# EasyEDA Pro project Geacon3.eprj, board Geacon_top2
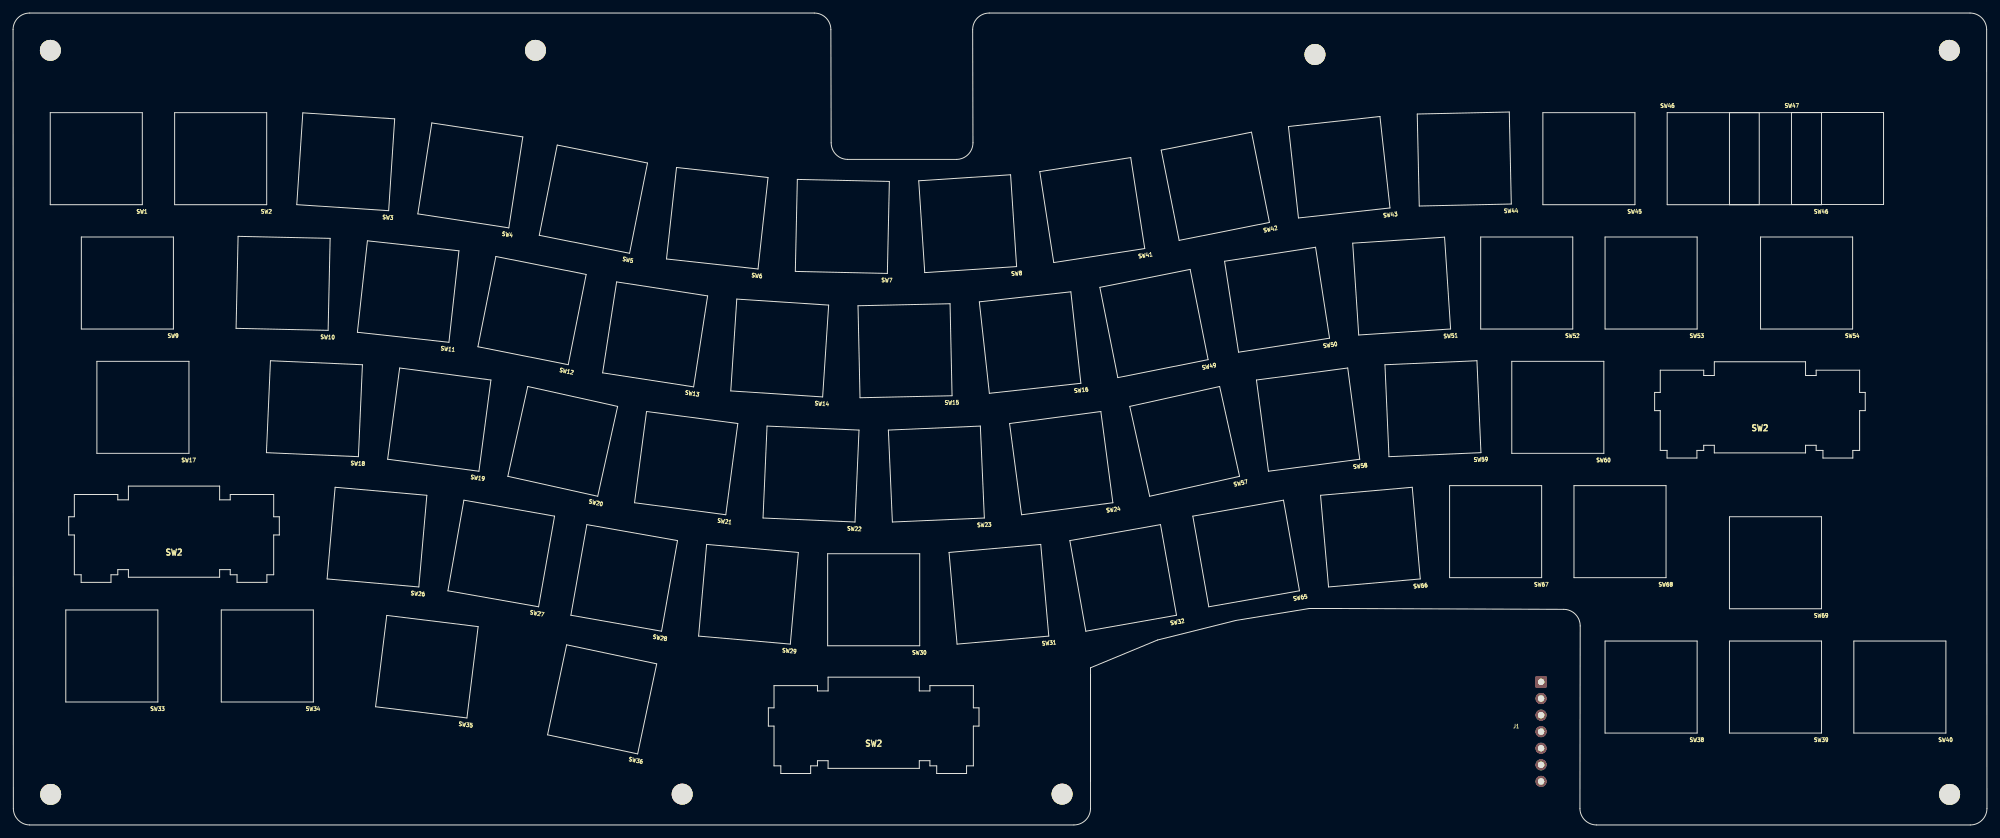
[diagram p5: board, top side]
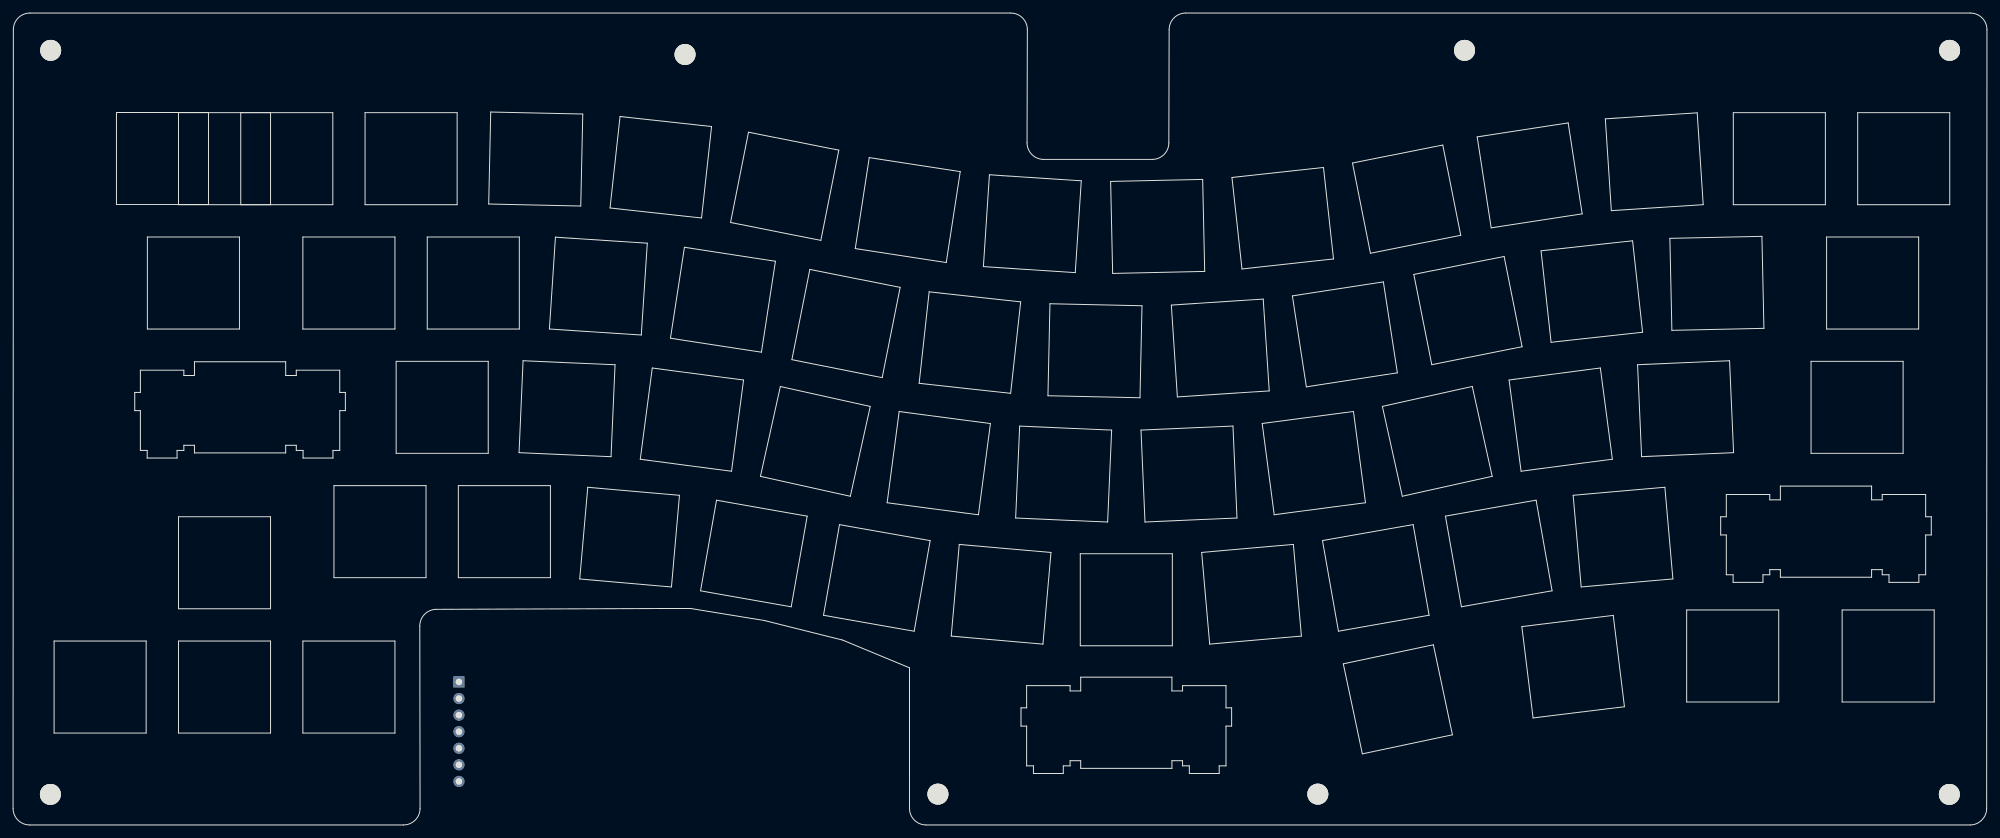
[diagram p6: board, bottom side, seen from below]

Outline 302.31 x 124.41 mm; copper layers: Top Layer, Bottom Layer. Coordinates in mm from the lower left corner of the outline.
Outline path: 165.02,22.94 165.02,6.73 ; 0,121.87 arc(0.74,123.66) 2.54,124.41 122.71,124.41 arc(124.51,123.66) 125.25,121.87 125.29,104.52 arc(126.04,102.73) 127.83,101.98 144.47,101.98 arc(146.27,102.73) 147.01,104.52 146.97,121.87 arc(147.71,123.66) 149.5,124.41 299.72,124.41 arc(301.52,123.66) 302.26,121.87 302.31,2.54 arc(301.56,0.74) 299.76,0 242.51,0 arc(240.72,0.74) 239.97,2.54 240.01,30.5 arc(239.27,32.29) 237.47,33.04 203.01,33.16 198.51,33.16 187.27,31.33 175.27,28.33 165.02,24.08 165.02,2.54 arc(164.27,0.74) 162.47,0 2.52,0 arc(0.76,0.77) 0.04,2.54 0,121.87
Stack: Top Layer 0.035mm / Dielectric1 1.51mm FR4 er 4.5 / Bottom Layer 0.035mm

## Design rules (mm)
spacing safeClearance (default): track to track 0.152, other pairs 0.152 to 0.3
track width trackWidth (default): min 0.127, default 0.254, max 2.54
differential pair differentialPair (default): width min 0.127, default 0.254, max 2.54; gap min 0.152, default 0.152
via viaSize (default): diameter min 0.5, default 0.61, max 10; hole min 0.3, default 0.305, max 6
net GND uses CopperRegion1

## Placement (name value [footprint] x y rotation side)
J1  ~  [roBa:pmw3610_connector]  234.02 14.29 0 top
REF**  -  [MountingHole:MountingHole_3.2mm_M3]  5.71 118.69 0 top
REF**#2  -  [MountingHole:MountingHole_3.2mm_M3]  80.01 118.69 0 top
REF**#3  -  [MountingHole:MountingHole_3.2mm_M3]  199.39 118.06 0 top
REF**#4  -  [MountingHole:MountingHole_3.2mm_M3]  296.55 118.69 0 top
REF**#5  -  [MountingHole:MountingHole_3.2mm_M3]  296.59 4.68 0 top
REF**#6  -  [MountingHole:MountingHole_3.2mm_M3]  160.66 4.72 0 top
REF**#7  -  [MountingHole:MountingHole_3.2mm_M3]  102.48 4.72 0 top
REF**#8  -  [MountingHole:MountingHole_3.2mm_M3]  5.76 4.68 0 top
SW1  SW_PUSH  [kbd_SW_Hole:SW_Hole_1u_JLC]  12.74 102.09 0 top
SW2  -  [kbd_SW_Hole:SW_Hole_1u_JLC]  31.8 102.09 0 top
SW2#2  -  [kbd_SW_Hole:PlateMount_225u]  24.65 44.94 0 top
SW2#3  -  [kbd_SW_Hole:PlateMount_225u]  131.81 15.66 0 top
SW2#4  -  [kbd_SW_Hole:PlateMount_225u]  267.54 63.99 0 top
SW3  SW_PUSH  [kbd_SW_Hole:SW_Hole_1u_JLC]  50.95 101.62 356.2 top
SW4  SW_PUSH  [kbd_SW_Hole:SW_Hole_1u_JLC]  70.03 99.53 351.2 top
SW5  SW_PUSH  [kbd_SW_Hole:SW_Hole_1u_JLC]  88.88 95.89 348.8 top
SW6  SW_PUSH  [kbd_SW_Hole:SW_Hole_1u_JLC]  107.85 92.97 353.8 top
SW7  SW_PUSH  [kbd_SW_Hole:SW_Hole_1u_JLC]  127.01 91.71 358.8 top
SW8  SW_PUSH  [kbd_SW_Hole:SW_Hole_1u_JLC]  146.2 92.13 3.8 top
SW9  SW_PUSH  [kbd_SW_Hole:SW_Hole_1u_JLC]  17.51 83.04 0 top
SW10  SW_PUSH  [kbd_SW_Hole:SW_Hole_1u_JLC]  41.36 82.99 358.8 top
SW11  SW_PUSH  [kbd_SW_Hole:SW_Hole_1u_JLC]  60.51 81.73 353.8 top
SW12  SW_PUSH  [kbd_SW_Hole:SW_Hole_1u_JLC]  79.48 78.81 348.8 top
SW13  SW_PUSH  [kbd_SW_Hole:SW_Hole_1u_JLC]  98.33 75.17 351.2 top
SW14  SW_PUSH  [kbd_SW_Hole:SW_Hole_1u_JLC]  117.42 73.08 356.2 top
SW15  SW_PUSH  [kbd_SW_Hole:SW_Hole_1u_JLC]  136.61 72.66 1.2 top
SW16  SW_PUSH  [kbd_SW_Hole:SW_Hole_1u_JLC]  155.76 73.92 6.2 top
SW17  SW_PUSH  [kbd_SW_Hole:SW_Hole_1u_JLC]  19.89 63.99 0 top
SW18  SW_PUSH  [kbd_SW_Hole:SW_Hole_1u_JLC]  46.15 63.78 357.5 top
SW19  SW_PUSH  [kbd_SW_Hole:SW_Hole_1u_JLC]  65.28 62.11 352.5 top
SW20  SW_PUSH  [kbd_SW_Hole:SW_Hole_1u_JLC]  84.18 58.77 347.5 top
SW21  SW_PUSH  [kbd_SW_Hole:SW_Hole_1u_JLC]  103.09 55.44 352.5 top
SW22  SW_PUSH  [kbd_SW_Hole:SW_Hole_1u_JLC]  122.21 53.77 357.5 top
SW23  SW_PUSH  [kbd_SW_Hole:SW_Hole_1u_JLC]  141.41 53.77 2.5 top
SW24  SW_PUSH  [kbd_SW_Hole:SW_Hole_1u_JLC]  160.53 55.44 7.5 top
SW26  SW_PUSH  [kbd_SW_Hole:SW_Hole_1u_JLC]  55.73 44.1 355 top
SW27  SW_PUSH  [kbd_SW_Hole:SW_Hole_1u_JLC]  74.77 41.6 350 top
SW28  SW_PUSH  [kbd_SW_Hole:SW_Hole_1u_JLC]  93.6 37.85 350 top
SW29  SW_PUSH  [kbd_SW_Hole:SW_Hole_1u_JLC]  112.63 35.35 355 top
SW30  SW_PUSH  [kbd_SW_Hole:SW_Hole_1u_JLC]  131.81 34.51 0 top
SW31  SW_PUSH  [kbd_SW_Hole:SW_Hole_1u_JLC]  150.99 35.35 5 top
SW32  SW_PUSH  [kbd_SW_Hole:SW_Hole_1u_JLC]  170.02 37.85 10 top
SW33  SW_PUSH  [kbd_SW_Hole:SW_Hole_1u_JLC]  15.13 25.89 0 top
SW34  SW_PUSH  [kbd_SW_Hole:SW_Hole_1u_JLC]  38.94 25.89 0 top
SW35  SW_PUSH  [kbd_SW_Hole:SW_Hole_1u_JLC]  63.37 24.25 353 top
SW36  SW_PUSH  [kbd_SW_Hole:SW_Hole_1u_JLC]  90.22 19.25 348.1 top
SW38  SW_PUSH  [kbd_SW_Hole:SW_Hole_1u_JLC]  250.87 21.13 0 top
SW39  SW_PUSH  [kbd_SW_Hole:SW_Hole_1u_JLC]  269.92 21.13 0 top
SW40  SW_PUSH  [kbd_SW_Hole:SW_Hole_1u_JLC]  288.97 21.13 0 top
SW41  SW_PUSH  [kbd_SW_Hole:SW_Hole_1u_JLC]  165.28 94.22 8.8 top
SW42  SW_PUSH  [kbd_SW_Hole:SW_Hole_1u_JLC]  184.13 97.86 11.2 top
SW43  SW_PUSH  [kbd_SW_Hole:SW_Hole_1u_JLC]  203.1 100.78 6.2 top
SW44  SW_PUSH  [kbd_SW_Hole:SW_Hole_1u_JLC]  222.26 102.04 1.2 top
SW45  SW_PUSH  [kbd_SW_Hole:SW_Hole_1u_JLC]  241.34 102.09 0 top
SW46  -  [kbd_SW_Hole:SW_Hole_1u_JLC]  269.92 102.09 0 top
SW46#2  -  [kbd_SW_Hole:SW_Hole_1u_JLC]  260.38 102.09 180 top
SW47  SW_PUSH  [kbd_SW_Hole:SW_Hole_1u_JLC]  279.42 102.12 180 top
SW49  SW_PUSH  [kbd_SW_Hole:SW_Hole_1u_JLC]  174.74 76.84 11.2 top
SW50  SW_PUSH  [kbd_SW_Hole:SW_Hole_1u_JLC]  193.58 80.48 8.8 top
SW51  SW_PUSH  [kbd_SW_Hole:SW_Hole_1u_JLC]  212.66 82.57 3.8 top
SW52  SW_PUSH  [kbd_SW_Hole:SW_Hole_1u_JLC]  231.82 83.04 0 top
SW53  SW_PUSH  [kbd_SW_Hole:SW_Hole_1u_JLC]  250.87 83.04 0 top
SW54  SW_PUSH  [kbd_SW_Hole:SW_Hole_1u_JLC]  274.68 83.04 0 top
SW57  SW_PUSH  [kbd_SW_Hole:SW_Hole_1u_JLC]  179.43 58.77 12.5 top
SW58  SW_PUSH  [kbd_SW_Hole:SW_Hole_1u_JLC]  198.34 62.11 7.5 top
SW59  SW_PUSH  [kbd_SW_Hole:SW_Hole_1u_JLC]  217.46 63.78 2.5 top
SW60  SW_PUSH  [kbd_SW_Hole:SW_Hole_1u_JLC]  236.58 63.99 0 top
SW65  SW_PUSH  [kbd_SW_Hole:SW_Hole_1u_JLC]  188.85 41.6 10 top
SW66  SW_PUSH  [kbd_SW_Hole:SW_Hole_1u_JLC]  207.88 44.1 5 top
SW67  SW_PUSH  [kbd_SW_Hole:SW_Hole_1u_JLC]  227.06 44.94 0 top
SW68  SW_PUSH  [kbd_SW_Hole:SW_Hole_1u_JLC]  246.11 44.94 0 top
SW69  SW_PUSH  [kbd_SW_Hole:SW_Hole_1u_JLC]  269.92 40.18 0 top

## Footprints (pads in the part's own frame, mm; a bottom-side part is the same pattern mirrored in y, then rotated)
MountingHole:MountingHole_3.2mm_M3
  round 3.2 hole 3.2: (0,0)
roBa:pmw3610_connector
  rect 1.7x1.7 hole 1: 1(0,7.62)
  round 1.7 hole 1: 2(0,5.08) 3(0,2.54) 4(0,0) 5(0,-2.54) 6(0,-5.08) 7(0,-7.62)

## Nets
3.3V: J1.4
GND: J1.3
CS2: J1.2
MOSI: J1.6
MOT: J1.7
SCK: J1.1
UNCONNECTED-(J1-NC-PAD5): J1.5

## Copper pours and planes (outline as drawn; the poured copper is in the pictures)
GND on Top Layer: -4.35,140.69 307.14,144.19 307.38,-2.68 -4.4,-1.41

## Text on the board
Component Marking Layer: MountingHole_3.2mm_M3
